# EasyEDA Pro project BLDCv5.eprj, board PCB4
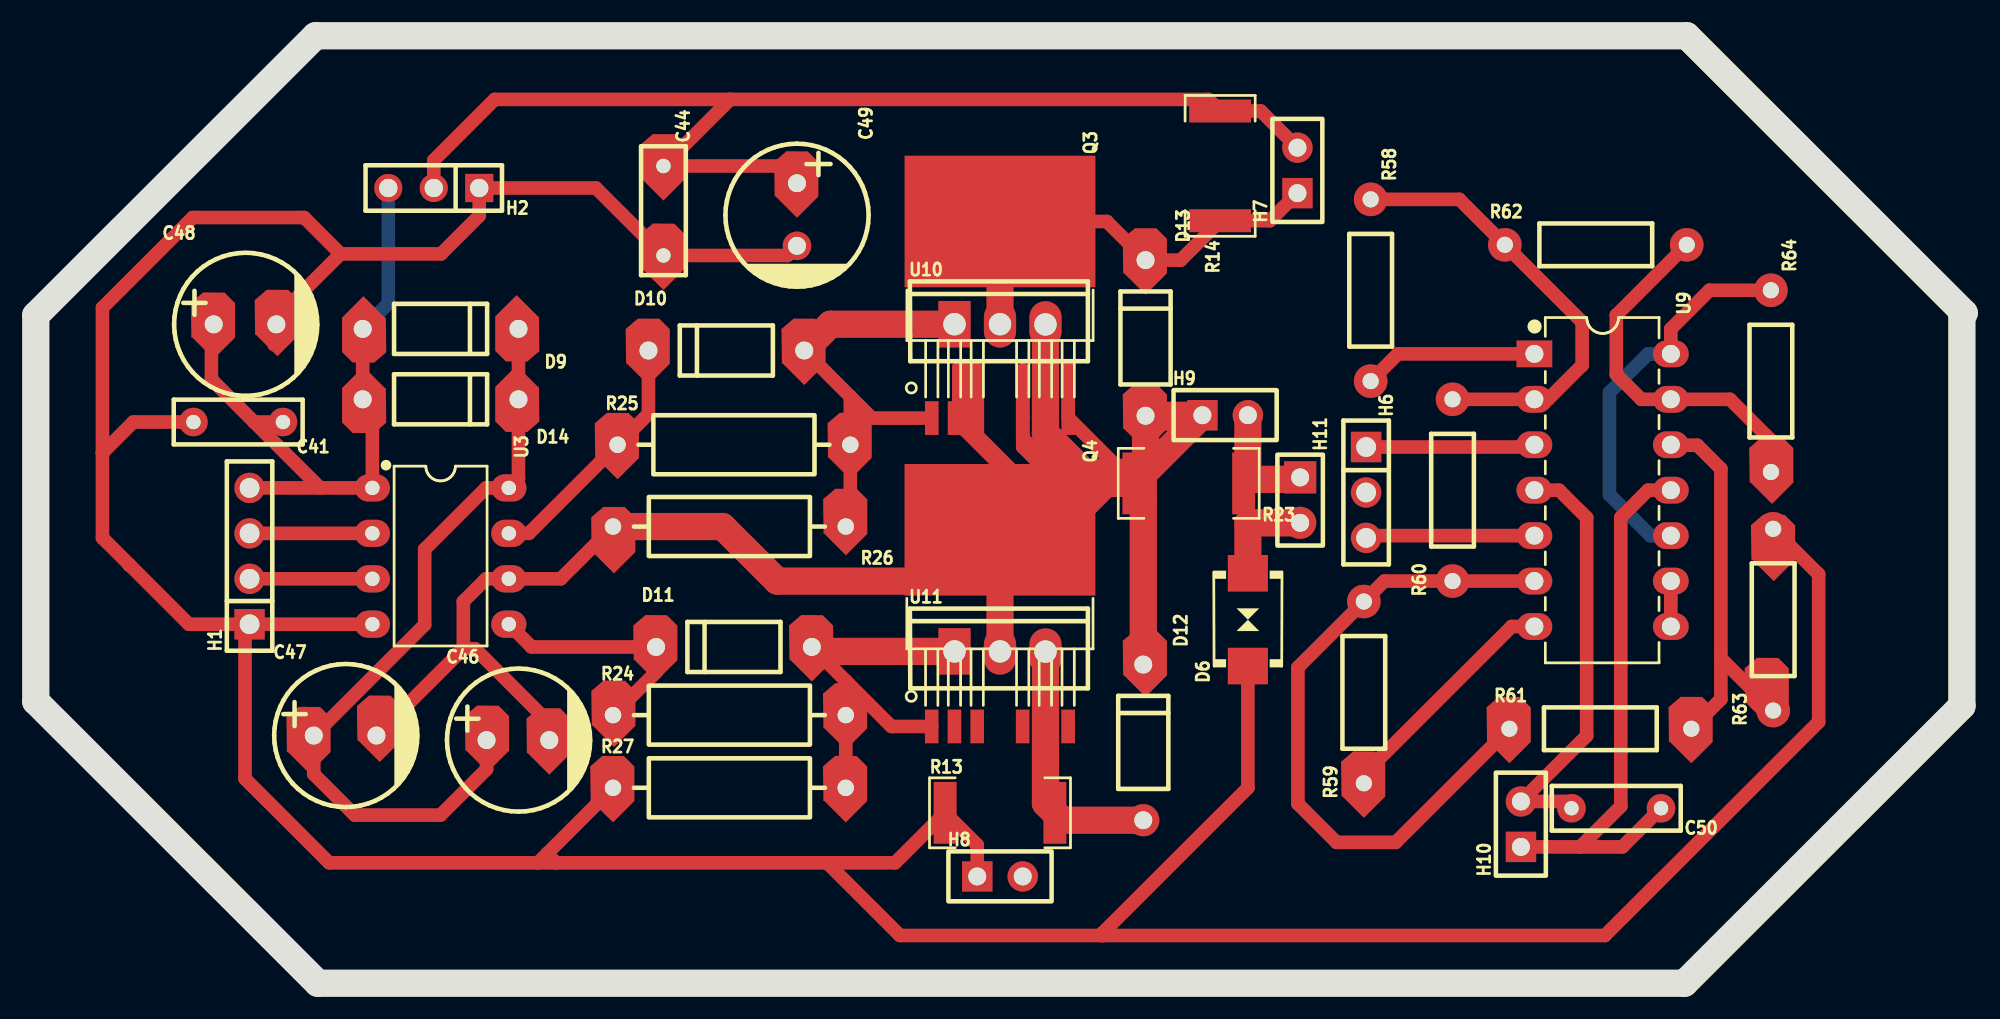
[diagram p12: board, top side]
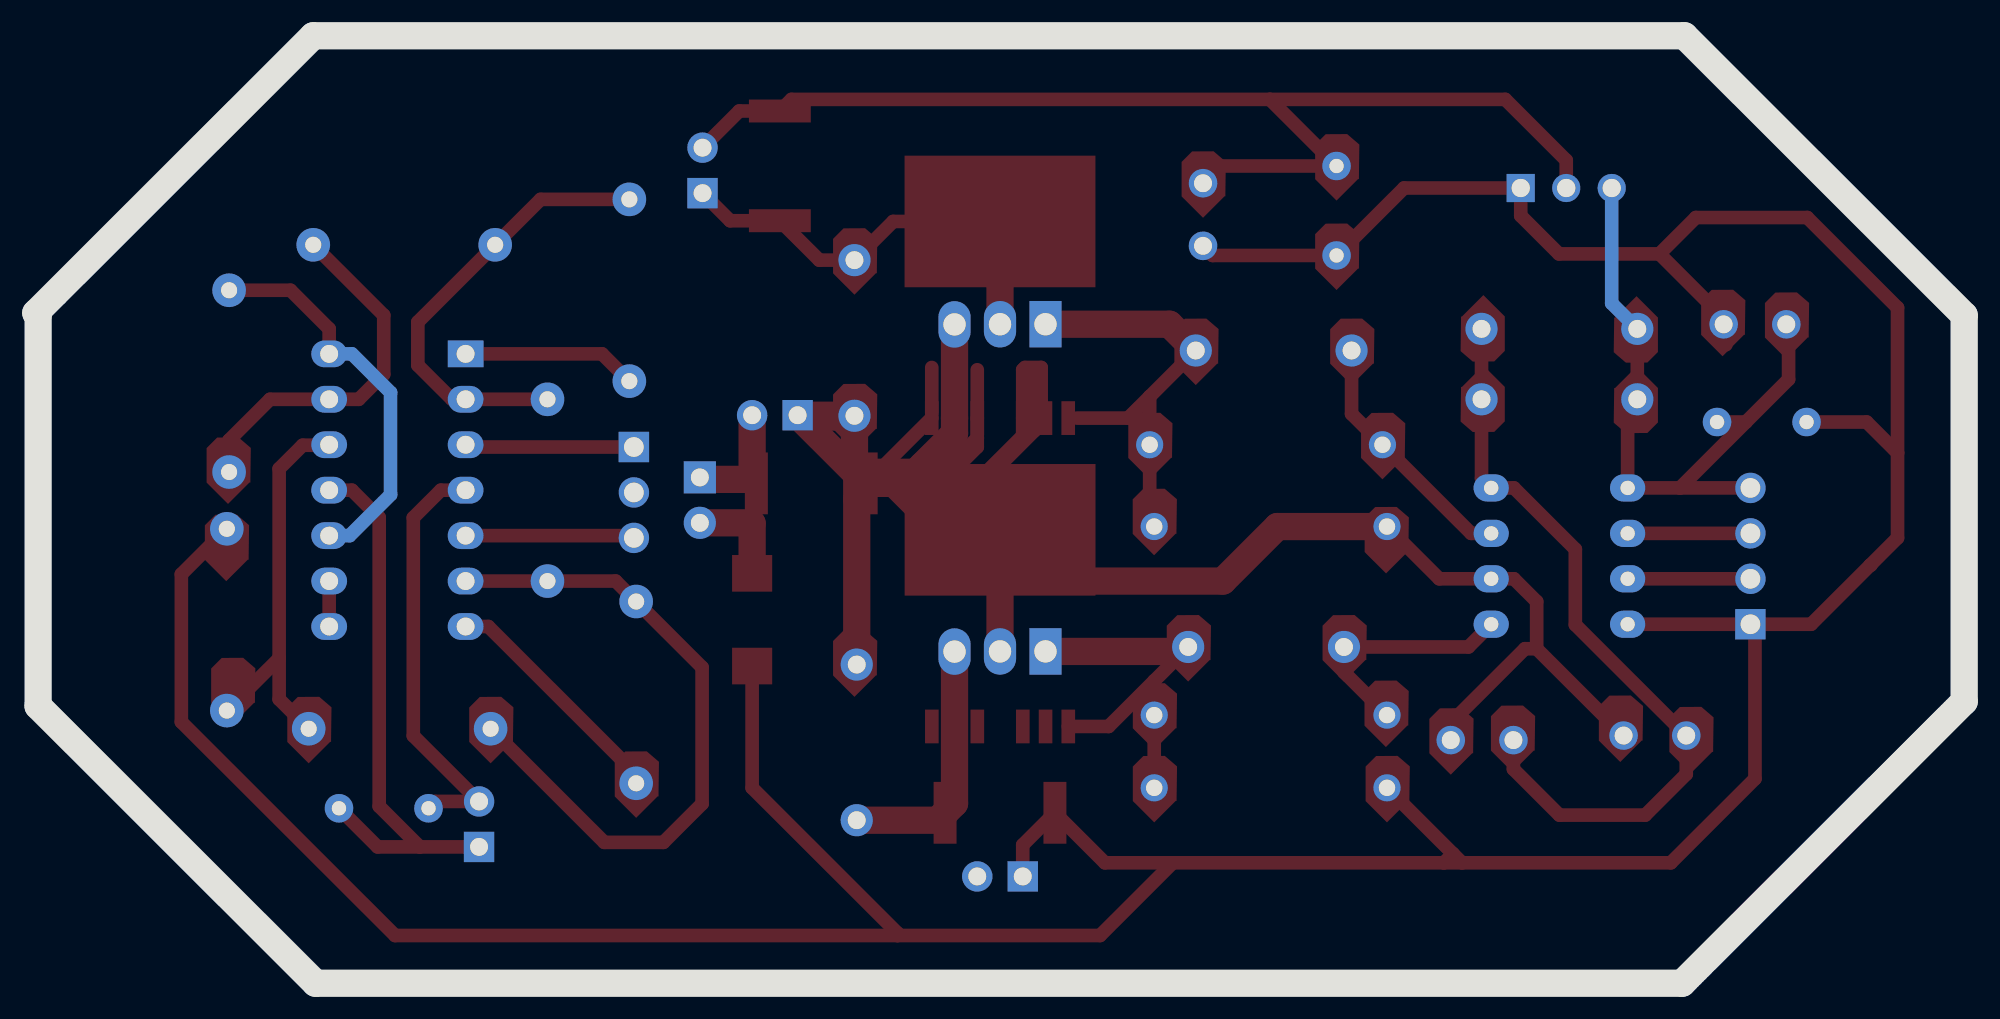
[diagram p13: board, bottom side, seen from below]

Outline 107.7 x 52.96 mm; copper layers: Top Layer, Bottom Layer. Coordinates in mm from the lower left corner of the outline.
Outline path: 0,37.34 0,15.75 15.75,0 92.08,0 107.57,15.49 107.57,37.34 107.7,37.46 92.2,52.96 15.62,52.96 0,37.34
Stack: Top Layer 0.035mm / Dielectric1 1.51mm FR4 er 4.5 / Bottom Layer 0.035mm

## Design rules (mm)
template: Custom Config
spacing copperThickness1oz (default): track to track 1, other pairs 0.152 to 0.5
spacing copperThickness2oz: track to track 0.203, other pairs 0.152 to 0.3
track width copperThickness1oz (default): min 0.127, default 0.254, max 2.54
track width copperThickness2oz: min 0.203, default 0.254, max 2.54
differential pair differentialPair (default): width min 0.127, default 0.254, max 2.54; gap min 0.152, default 0.152
via viaSize (default): diameter min 0.5, default 0.61, max 10; hole min 0.3, default 0.305, max 6.3

## Placement (name value [footprint] x y rotation side)
C41  470nF  [CAP-TH_L7.2-W2.5-P5.00-D0.5]  11.3 31.37 180 top
C44  470nF  [CAP-TH_L7.2-W2.5-P5.00-D0.5]  35.05 43.18 270 top
C46  100uF  [CAP-TH_BD8.0-P3.50-D0.6-FD]  26.92 13.59 0 top
C47  100uF  [CAP-TH_BD8.0-P3.50-D0.6-FD]  17.27 13.84 0 top
C48  100uF  [CAP-TH_BD8.0-P3.50-D0.6-FD]  11.68 36.83 0 top
C49  100uF  [CAP-TH_BD8.0-P3.50-D0.6-FD]  42.51 42.97 270 top
C50  470nF  [CAP-TH_L7.2-W2.5-P5.00-D0.5]  88.27 9.78 180 top
D6  P6SMB6.8CA/TR13  [SMB_L4.6-W3.6-LS5.3-BI]  67.69 20.32 90 top
D9  -  [DO-41_BD2.4-L4.7-P8.70-D0.9-RD]  22.61 36.58 180 top
D10  -  [DO-41_BD2.4-L4.7-P8.70-D0.9-RD]  38.56 35.37 0 top
D11  -  [DO-41_BD2.4-L4.7-P8.70-D0.9-RD]  38.99 18.8 0 top
D12  -  [DO-41_BD2.4-L4.7-P8.70-D0.9-RD]  61.85 13.46 270 top
D13  -  [DO-41_BD2.4-L4.7-P8.70-D0.9-RD]  61.98 36.07 270 top
D14  -  [DO-41_BD2.4-L4.7-P8.70-D0.9-RD]  22.61 32.64 180 top
H1  -  [HDR-TH_4P-P2.54-V-F]  11.94 23.88 90 top
H2  -  [HDR-TH_3P-P2.54-V-F]  22.23 44.45 180 top
H6  -  [HDR-TH_3P-P2.54-V-M]  74.3 27.43 270 top
H7  -  [HDR-TH_2P-P2.54-V-F]  70.46 45.43 90 top
H8  -  [HDR-TH_2P-P2.54-V-F]  53.85 5.97 0 top
H9  -  [HDR-TH_2P-P2.54-V-F]  66.42 31.75 0 top
H10  -  [HDR-TH_2P-P2.54-V-F]  82.94 8.89 90 top
H11  -  [HDR-TH_2P-P2.54-V-M-1]  70.61 27 270 top
NOREF  -  [Pad_e318]  82.27 14.15 0 top
NOREF#2  -  [Pad_e251]  13.46 36.9 180 top
NOREF#3  -  [Pad_e270]  32.27 15.06 180 top
NOREF#4  -  [Pad_e277]  32.46 30.02 0 top
NOREF#5  -  [Pad_e320]  92.43 14.15 0 top
NOREF#6  -  [Pad_e269]  32.2 10.85 0 top
NOREF#7  -  [Pad_e267]  25.2 13.66 180 top
NOREF#8  -  [Pad_e282]  61.95 40.34 0 top
NOREF#9  -  [Pad_e304]  42.48 44.64 0 top
NOREF#10  -  [Pad_e271]  34.61 18.72 0 top
NOREF#11  -  [Pad_e276]  42.88 35.29 0 top
NOREF#12  -  [Pad_e321]  96.93 28.65 180 top
NOREF#13  -  [Pad_e262]  26.88 36.61 270 top
NOREF#14  -  [Pad_e275]  34.18 35.29 0 top
NOREF#15  -  [Pad_e274]  45.2 14.91 0 top
NOREF#16  -  [Pad_e265]  15.24 13.59 0 top
NOREF#17  -  [Pad_e254]  18.33 36.55 90 top
NOREF#18  -  [Pad_e263]  26.88 32.67 270 top
NOREF#19  -  [Pad_e323]  96.68 16.33 180 top
NOREF#20  -  [Pad_e315]  74.14 11.1 0 top
NOREF#21  -  [Pad_e303]  35.02 45.61 0 top
NOREF#22  -  [Pad_e273]  45.2 10.85 0 top
NOREF#23  -  [Pad_e268]  28.64 13.51 0 top
NOREF#24  -  [Pad_e312]  61.95 17.86 0 top
NOREF#25  -  [Pad_e250]  9.9 36.76 0 top
NOREF#26  -  [Pad_e278]  32.26 24.76 0 top
NOREF#27  -  [Pad_e281]  61.95 31.64 0 top
NOREF#28  -  [Pad_e279]  45.21 25.78 0 top
NOREF#29  -  [Pad_e272]  43.31 18.72 0 top
NOREF#30  -  [Pad_e266]  19.18 14.22 180 top
NOREF#31  -  [Pad_e322]  97.03 24.33 0 top
NOREF#32  -  [Pad_e280]  45.46 30.02 0 top
NOREF#33  -  [Pad_e253]  18.33 32.61 90 top
NOREF#34  -  [Pad_e302]  35.02 40.61 0 top
Q3  IRF2804STRL7PP  [D2PAK-7_L10.6-W9.6-P1.27-LS15.9-BR]  53.85 37.08 270 top
Q4  IRF2804STRL7PP  [D2PAK-7_L10.6-W9.6-P1.27-LS15.9-BR]  53.84 19.85 270 top
R13  5mΩ  [R2512]  53.85 9.52 0 top
R14  5mΩ  [R2512]  66.14 45.69 90 top
R23  5mΩ  [R2512]  64.39 27.94 180 top
R24  11  [RES-TH_BD3.3-L9.0-P13.00-D0.6]  38.73 14.99 0 top
R25  11  [RES-TH_BD3.3-L9.0-P13.00-D0.6]  38.99 30.1 0 top
R26  11k  [RES-TH_BD3.3-L9.0-P13.00-D0.6]  38.73 25.53 180 top
R27  11k  [RES-TH_BD3.3-L9.0-P13.00-D0.6]  38.73 10.92 0 top
R58  10kΩ  [R_AXIAL-0.4]  74.55 38.73 270 top
R59  10kΩ  [R_AXIAL-0.4]  74.17 16.26 90 top
R60  10kΩ  [R_AXIAL-0.4]  79.12 27.56 90 top
R61  10kΩ  [R_AXIAL-0.4]  87.38 14.22 0 top
R62  10kΩ  [R_AXIAL-0.4]  87.12 41.27 0 top
R63  10kΩ  [R_AXIAL-0.4]  97.03 20.32 90 top
R64  10kΩ  [R_AXIAL-0.4]  96.9 33.65 270 top
U3  IR2104PBF  [DIP-8_L9.9-W6.6-P2.54-LS7.62-BL]  22.61 23.88 270 top
U9  LM324N  [DIP-14_L19.3-W7.0-P2.54-LS7.6-BL]  87.5 27.56 270 top
U10  IRFZ44N  [TO-220-3_L9.9-W4.5-P2.54-L]  53.85 36.83 0 top
U11  IRFZ44N  [TO-220-3_L9.9-W4.5-P2.54-L]  53.85 18.54 0 top

## Footprints (pads in the part's own frame, mm; a bottom-side part is the same pattern mirrored in y, then rotated)
CAP-TH_BD8.0-P3.50-D0.6-FD
  round 1.6 hole 1: 1(-1.75,0) 2(1.75,0)
CAP-TH_L7.2-W2.5-P5.00-D0.5
  round 1.6 hole 0.8: 1(-2.5,0) 2(2.5,0)
D2PAK-7_L10.6-W9.6-P1.27-LS15.9-BR
  rect 1.887x0.762 smd: 1(5.495,-3.81) 2(5.495,-2.54) 3(5.495,-1.27) 5(5.495,1.27) 6(5.495,2.54) 7(5.495,3.81)
  rect 7.356x10.66 smd: 4(-5.495,0)
DIP-8_L9.9-W6.6-P2.54-LS7.62-BL
  oval 1.524x1.97 hole 0.8: 1(-3.81,-3.81) 2(-1.27,-3.81) 3(1.27,-3.81) 4(3.81,-3.81) 5(3.81,3.81) 6(1.27,3.81) 7(-1.27,3.81) 8(-3.81,3.81)
DIP-14_L19.3-W7.0-P2.54-LS7.6-BL
  rect 1.5x2 hole 1: 1(-7.62,-3.81)
  oval 1.5x2 hole 1: 2(-5.08,-3.81) 3(-2.54,-3.81) 4(0,-3.81) 5(2.54,-3.81) 6(5.08,-3.81) 7(7.62,-3.81) 8(7.62,3.81) 9(5.08,3.81) 10(2.54,3.81) 11(0,3.81) 12(-2.54,3.81) 13(-5.08,3.81) 14(-7.62,3.81)
DO-41_BD2.4-L4.7-P8.70-D0.9-RD
  round 1.8 hole 1: 1(-4.35,0) 2(4.35,0)
HDR-TH_2P-P2.54-V-F
  rect 1.7x1.7 hole 1: 1(-1.27,0)
  round 1.7 hole 1: 2(1.27,0)
HDR-TH_2P-P2.54-V-M-1
  rect 1.8x1.8 hole 1: 1(-1.27,0)
  round 1.8 hole 1: 2(1.27,0)
HDR-TH_3P-P2.54-V-F
  rect 1.575x1.575 hole 1.02: 1(-2.54,0)
  round 1.575 hole 1.02: 2(0,0) 3(2.54,0)
HDR-TH_3P-P2.54-V-M
  rect 1.7x1.7 hole 1.1: 1(-2.54,0)
  round 1.7 hole 1.1: 2(0,0) 3(2.54,0)
HDR-TH_4P-P2.54-V-F
  rect 1.7x1.7 hole 1.1: 1(-3.81,0)
  round 1.7 hole 1.1: 2(-1.27,0) 3(1.27,0) 4(3.81,0)
Pad_e250
  custom 2.47x3.718 smd: 17(0,0)
Pad_e251
  custom 2.47x3.718 smd: 17(0,0)
Pad_e253
  custom 3.718x2.47 smd: 17(0,0)
Pad_e254
  custom 3.718x2.47 smd: 17(0,0)
Pad_e262
  custom 3.718x2.47 smd: 17(0,0)
Pad_e263
  custom 3.718x2.47 smd: 17(0,0)
Pad_e265
  custom 2.47x3.718 smd: 17(0,0)
Pad_e266
  custom 2.47x3.718 smd: 17(0,0)
Pad_e267
  custom 2.47x3.718 smd: 17(0,0)
Pad_e268
  custom 2.47x3.718 smd: 17(0,0)
Pad_e269
  custom 2.47x3.718 smd: 17(0,0)
Pad_e270
  custom 2.47x3.718 smd: 17(0,0)
Pad_e271
  custom 2.47x3.718 smd: 17(0,0)
Pad_e272
  custom 2.47x3.718 smd: 17(0,0)
Pad_e273
  custom 2.47x3.718 smd: 17(0,0)
Pad_e274
  custom 2.47x3.718 smd: 17(0,0)
Pad_e275
  custom 2.47x3.718 smd: 17(0,0)
Pad_e276
  custom 2.47x3.718 smd: 17(0,0)
Pad_e277
  custom 2.47x3.718 smd: 17(0,0)
Pad_e278
  custom 2.47x3.718 smd: 17(0,0)
Pad_e279
  custom 2.47x3.718 smd: 17(0,0)
Pad_e280
  custom 2.47x3.718 smd: 17(0,0)
Pad_e281
  custom 2.47x3.718 smd: 17(0,0)
Pad_e282
  custom 2.47x3.718 smd: 17(0,0)
Pad_e302
  custom 2.47x3.718 smd: 17(0,0)
Pad_e303
  custom 2.47x3.718 smd: 17(0,0)
Pad_e304
  custom 2.47x3.718 smd: 17(0,0)
Pad_e312
  custom 2.47x3.718 smd: 17(0,0)
Pad_e315
  custom 2.47x3.718 smd: 17(0,0)
Pad_e318
  custom 2.47x3.718 smd: 17(0,0)
Pad_e320
  custom 2.47x3.718 smd: 17(0,0)
Pad_e321
  custom 2.47x3.718 smd: 17(0,0)
Pad_e322
  custom 2.47x3.718 smd: 17(0,0)
Pad_e323
  custom 2.47x3.718 smd: 17(0,0)
R2512
  rect 1.282x3.456 smd: 1(-3.067,0) 2(3.067,0)
R_AXIAL-0.4
  round 1.879 hole 0.899: 1(-5.08,0) 2(5.08,0)
RES-TH_BD3.3-L9.0-P13.00-D0.6
  round 1.524 hole 0.914: 1(-6.5,0) 2(6.5,0)
SMB_L4.6-W3.6-LS5.3-BI
  rect 2.047x2.241 smd: 1(-2.591,0) 2(2.591,0)
TO-220-3_L9.9-W4.5-P2.54-L
  rect 1.8x2.6 hole 1.25: 1(-2.54,0.005)
  oval 1.8x2.6 hole 1.25: 2(0,0.005) 3(2.54,-0.005)

## Nets
12V: C41.1 C48.1 D9.2 D14.2 H1.4 H2.3 NOREF#17.17 NOREF#25.17 NOREF#33.17 U3.1
+5V: C50.2 H10.2 U9.4
GND: C41.2 C44.2 C48.2 C49.2 D6.1 H1.1 H2.1 H8.1 NOREF#2.17 NOREF#6.17 NOREF#31.17 NOREF#34.17 R13.1 R27.1 R63.2 U3.4
VCC: C44.1 C49.1 H2.2 H7.2 NOREF#9.17 NOREF#21.17 R14.2
CS_AMPOUT: U9.8 U9.9
HIN: H1.3 U3.2
HS_GATE: D10.2 NOREF#11.17 NOREF#28.17 NOREF#32.17 Q3.1 R25.2 R26.1 U10.1
HS_SENSE: D13.1 H7.1 NOREF#8.17 Q3.4 R14.1 U10.2
HSO: D10.1 NOREF#4.17 NOREF#14.17 R25.1 U3.7
LOW_RAIL: C50.1 H10.1 U9.11
LS_GATE: D11.2 NOREF#15.17 NOREF#22.17 NOREF#29.17 Q4.1 R24.2 R27.2 U11.1
LSO: D11.1 NOREF#3.17 NOREF#10.17 R24.1 U3.5
NB_CS: R64.1 U9.10 U9.14
SD#: H1.2 U3.3
SN_SENSE+: C46.2 C47.2 D12.1 D13.2 H9.1 NOREF#23.17 NOREF#24.17 NOREF#26.17 NOREF#27.17 NOREF#30.17 Q3.2 Q3.3 Q3.5 Q3.6 Q3.7 Q4.4 R23.2 R26.2 U3.6 U10.3 U11.2
SN_SENSE-: D6.2 H9.2 H11.1 H11.2 R23.1
VB: C46.1 C47.1 D9.1 D14.1 NOREF#7.17 NOREF#13.17 NOREF#16.17 NOREF#18.17 U3.8
$1N1517: R58.2 U9.1
$1N1518: NOREF#20.17 R59.1 U9.7
$1N1519: NOREF.17 R59.2 R60.1 R61.1 U9.6
$1N1520: R58.1 R60.2 R62.1 U9.2
$1N1523: NOREF#5.17 NOREF#19.17 R61.2 R63.1 U9.12
$1N1525: NOREF#12.17 R62.2 R64.2 U9.13
$1N1721: H6.1 U9.3
$1N1748: H6.3 U9.5
$1N4504: D12.2 Q4.2 Q4.3 Q4.5 Q4.6 Q4.7 R13.2 U11.3

Pads without a net: H6 2; H8 2

## Routing (per net, layer and track width the routed paths; a pad name or vN(x,y) marks a point on that pad's centre or on a via; arc(x,y) is an arc through that point)
12V: length 36.6
  Top Layer w0.762: H1.4 15.88,27.69 ; 15.88,27.69 U3.1 18.8,32.1 D14.2 18.26,36.21 ; 15.88,27.69 12.19,31.37 ; 9.81,35.69 9.81,33.75 12.19,31.37 ; 12.19,31.37 14.18,31.37
  Bottom Layer w0.762: H2.3 19.69,38 D9.2
+5V: length 23.9
  Top Layer w0.762: U9.4 85.07,27.56 86.61,26.02 86.61,13.83 H10.2 85.38,10.16 C50.2
GND: length 242.2
  Top Layer w0.762: 5.25,23.37 5.21,23.37 ; 5.25,23.37 8.55,20.07 H1.1 ; 5.25,23.37 3.72,24.89 3.72,29.65 ; 59.57,2.67 87.63,2.67 99.57,14.6 99.57,22.86 R63.2 ; 59.57,2.67 48.26,2.67 44.2,6.73 ; 59.57,2.67 59.57,2.8 67.69,10.92 D6.1 ; H1.1 18.53,20.07 18.55,20.08 ; H1.1 11.68,19.81 11.68,11.43 16.38,6.73 28.04,6.73 ; 28.55,7.24 29.06,6.73 ; 28.55,7.24 28.04,6.73 ; 28.55,7.24 R27.1 ; 29.06,6.73 44.2,6.73 ; 29.06,6.73 28.04,6.73 ; C49.2 41.97,40.68 C44.2 31.28,44.45 24.77,44.45 24.77,42.9 22.63,40.77 17.02,40.77 ; 17.02,40.77 13.31,37.06 13.31,35.69 ; 17.02,40.77 14.99,42.8 8.76,42.8 3.72,37.76 3.72,29.65 ; 3.72,29.65 5.45,31.37 8.76,31.37 8.78,31.35 ; 44.2,6.73 47.99,6.73 R13.1 52.58,7.73 H8.1
VCC: length 65.4
  Top Layer w0.762: C49.1 41.55,45.68 C44.1 38.78,49.4 ; 38.78,49.4 25.63,49.4 22.23,46 H2.2 ; 38.78,49.4 65.49,49.4 R14.2 68.41,48.75 H7.2
CS_AMPOUT: length 2.5
  Top Layer w0.762: U9.8 U9.9
HIN: length 6.9
  Top Layer w0.762: H1.3 U3.2
HS_GATE: length 24.6
  Top Layer w0.762: 45.49,32.79 D10.2 ; 45.49,32.79 R25.2 45.49,25.78 R26.1 ; 45.49,32.79 46.69,31.59 49.55,31.59
  Top Layer w1.524: U10.1 44.38,36.83 D10.2
HS_SENSE: length 24.8
  Top Layer w0.762: H7.1 68.92,42.62 R14.1 63.94,40.42 D13.1 59.81,42.58 Q3.4
  Top Layer w1.524: U10.2 Q3.4
HSO: length 14.1
  Top Layer w0.762: U3.7 27.54,25.15 R25.1 34.21,31.82 D10.1
LOW_RAIL: length 31.5
  Top Layer w0.762: C50.1 88.61,7.62 86.25,7.62 ; 86.25,7.62 H10.1 ; 86.25,7.62 88.52,9.89 88.52,26.03 90.04,27.56 U9.11
LS_GATE: length 22.2
  Top Layer w0.762: 45.23,16.9 47.78,14.35 ; 45.23,16.9 R24.2 R27.2 ; 45.23,16.9 43.59,18.55 ; 47.78,14.35 Q4.1
  Top Layer w1.524: D11.2 43.59,18.55 U11.1
LSO: length 13.5
  Top Layer w0.762: 26.42,19.95 26.53,19.95 27.69,18.8 D11.1 34.64,17.39 R24.1
NB_CS: length 22.3
  Top Layer w0.762: R64.1 93.47,38.73 91.31,36.58 U9.14
  Bottom Layer w0.762: U9.10 90.17,25.02 87.88,27.3 87.88,33.02 90.04,35.18 U9.14
SD#: length 6.9
  Top Layer w0.762: H1.2 U3.3
SN_SENSE+: length 167.3
  Top Layer w0.762: 55.12,30.48 55.12,29.97 57.15,27.94 ; 55.12,30.48 Q3.5 55.12,34.29 ; 55.12,30.48 56.66,28.94 60.32,28.94 ; 60.31,27.94 57.71,25.34 Q4.4 53.84,28.96 51.91,30.9 51.91,32.89 ; C47.2 23.88,18.7 ; 23.88,18.7 23.88,21.34 25.15,22.61 U3.6 29.31,22.61 R26.2 ; 23.88,18.7 24.53,18.7 28.67,14.55 C46.2 ; 56.44,27.94 55.25,27.94 52.58,30.61 Q3.3 52.58,34.29 52.45,34.42 51.55,34.42 51.55,32.53 51.91,32.89 ; 61.98,28.59 61.98,17.94 D12.1 ; Q3.7 57.67,31.59 60.32,28.94 ; 57.66,31.88 57.66,34.42 ; 51.91,32.89 52.2,32.89 ; 51.91,32.89 51.94,32.93 51.94,34.04 ; 60.32,28.94 61.98,28.94 ; 60.32,28.94 60.81,28.45 ; 61.21,27.69 61.85,27.05
  Top Layer w1.524: Q4.4 53.85,25.34 U11.2 ; Q4.4 50.98,22.48 41.4,22.48 38.35,25.53 R26.2 ; Q4.4 56.44,27.94 59.18,27.94 ; 65.05,31.64 61.85,28.45 D12.1 ; 65.05,31.64 H9.1 62.01,31.75 D13.2 61.98,31.64 ; 65.05,31.64 61.98,31.64 ; 61.98,31.64 NOREF#27.17 ; 61.98,31.64 61.98,28.59 61.7,28.32 ; 61.7,28.32 R23.2 59.18,27.94 ; 61.7,28.32 59.44,28.32 ; U10.3 Q3.6 56.39,30.73 59.18,27.94
SN_SENSE-: length 15.1
  Top Layer w0.762: R23.1 67.69,27.7 ; 67.69,27.7 67.69,28.16 ; 67.69,27.7 67.69,25.7
  Top Layer w1.524: D6.2 67.69,25.7 67.73,25.73 H11.2 ; H9.2 67.69,28.16 70.5,28.16 H11.1
VB: length 43.7
  Top Layer w0.762: D9.1 D14.1 26.96,28.23 U3.8 25.15,27.69 21.72,24.26 21.72,20.04 C47.1 15.52,11.69 17.81,9.4 22.61,9.4 25.17,11.97 C46.1
$1N1517: length 9.8
  Top Layer w0.762: U9.1 76.07,35.18 R58.2
$1N1518: length 13.5
  Top Layer w0.762: R59.1 74.17,11.68 82.42,19.94 U9.7
$1N1519: length 38.2
  Top Layer w0.762: R61.1 75.95,7.87 72.64,7.87 70.48,10.03 70.48,17.65 R59.2 75.31,22.48 R60.1 U9.6
$1N1520: length 25.1
  Top Layer w0.762: R58.1 79.5,43.81 R62.1 86.36,36.96 86.36,34.54 84.45,32.64 U9.2 R60.2
$1N1523: length 22.7
  Top Layer w0.762: 94.11,18.16 R63.1 ; 94.11,18.16 94.11,15.87 R61.2 ; 94.11,18.16 94.11,28.76 92.79,30.07 91.34,30.07 U9.12
$1N1525: length 20.8
  Top Layer w0.762: R62.2 88.27,37.34 88.27,34.04 89.66,32.64 U9.13 94.61,32.64 96.9,30.35 R64.2
$1N1721: length 9.5
  Top Layer w0.762: H6.1 83.57,29.97 U9.3
$1N1748: length 9.5
  Top Layer w0.762: U9.5 74.42,25.02 H6.3
$1N4504: length 14.3
  Top Layer w1.524: U11.3 56.39,10.05 R13.2 57.33,9.11 D12.2
